# EAGLE board BMS (EAGLE 7.5.0), part 1 of 2
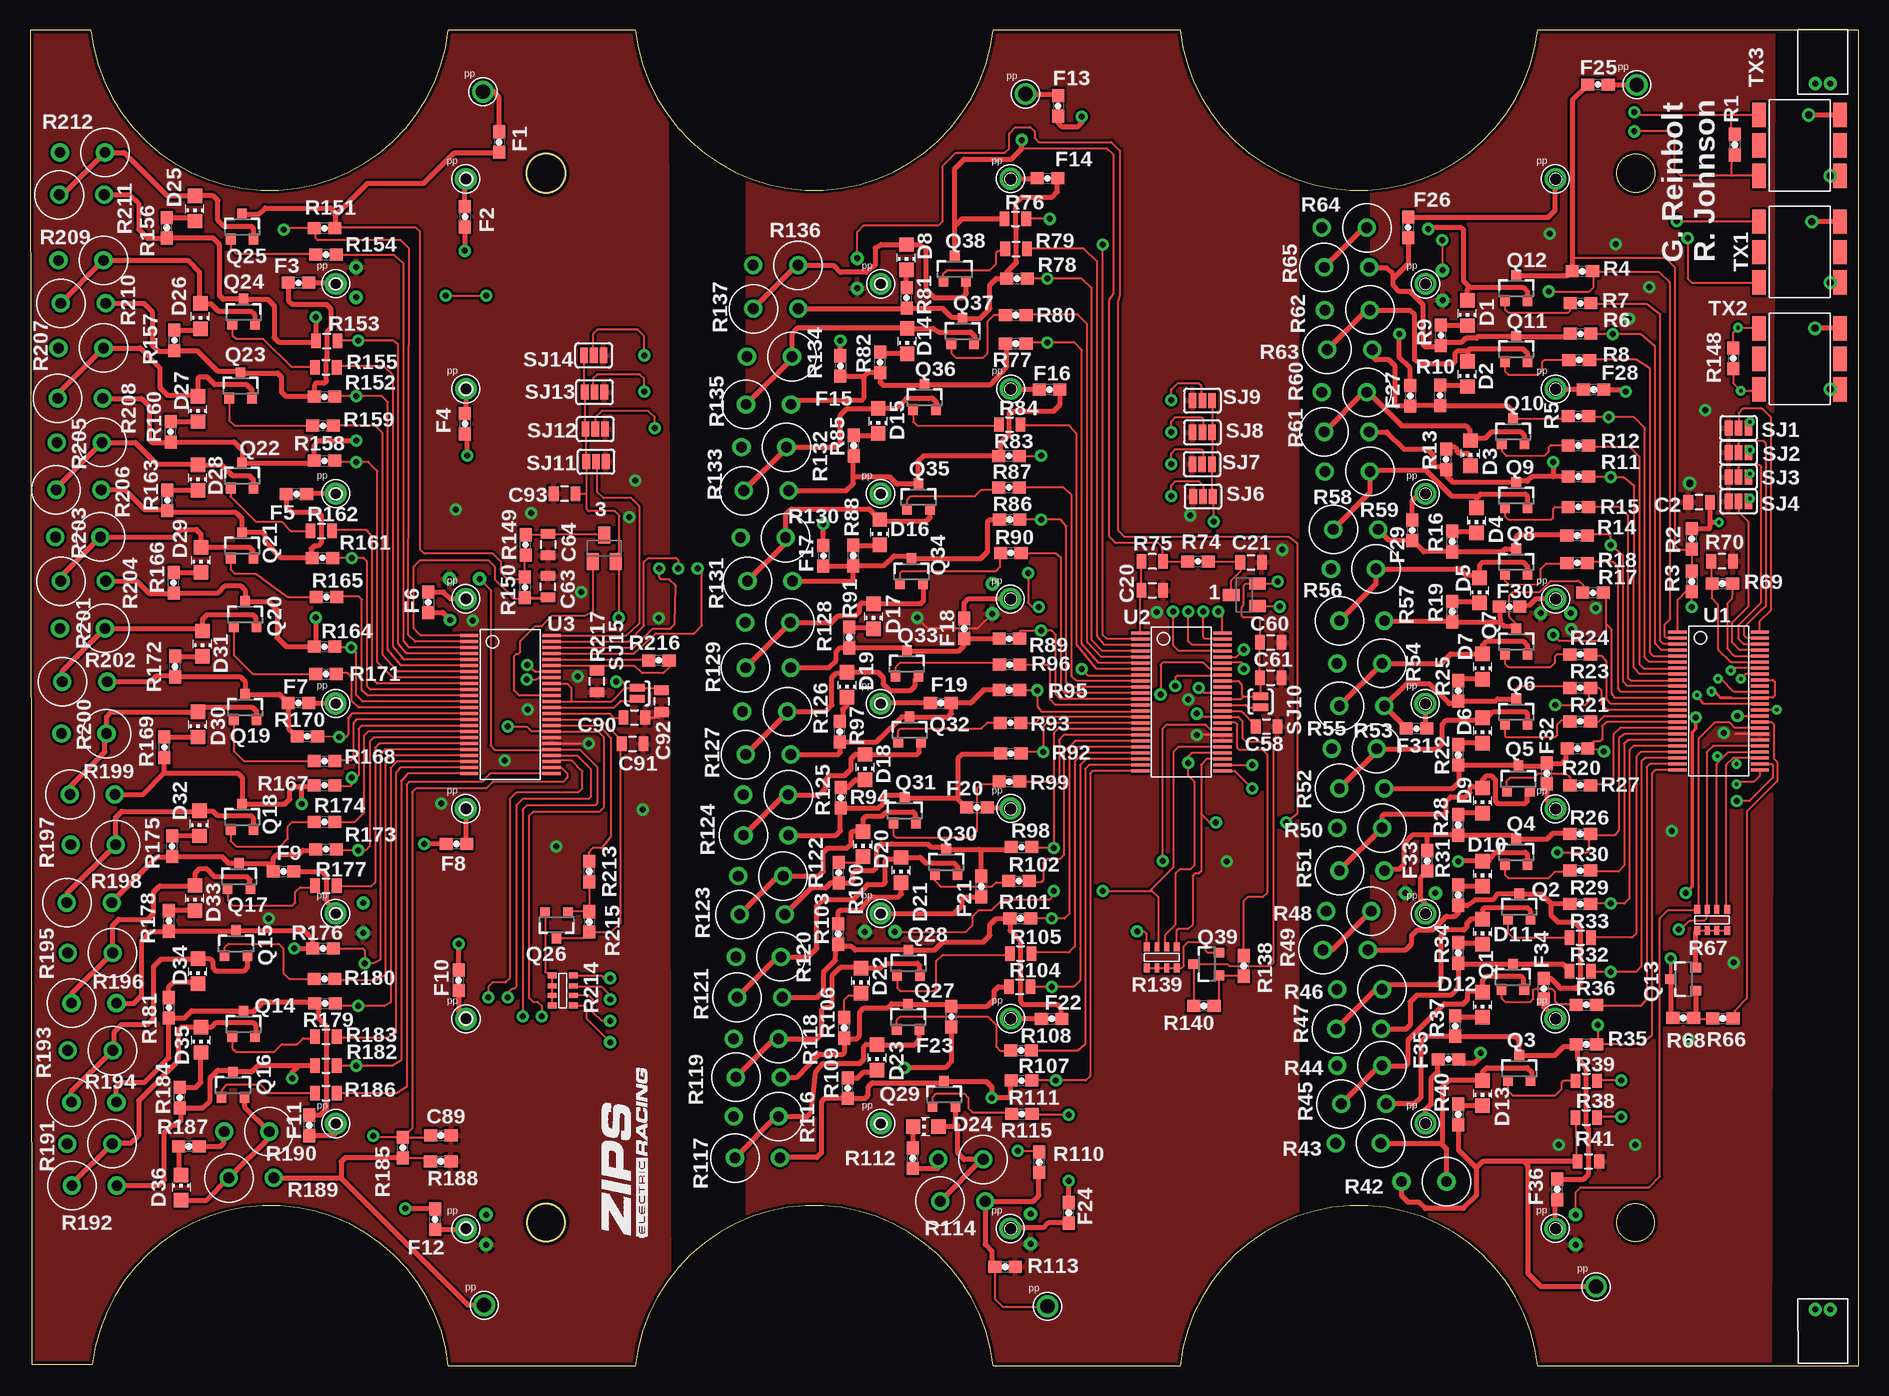
[diagram p3: board, top side]
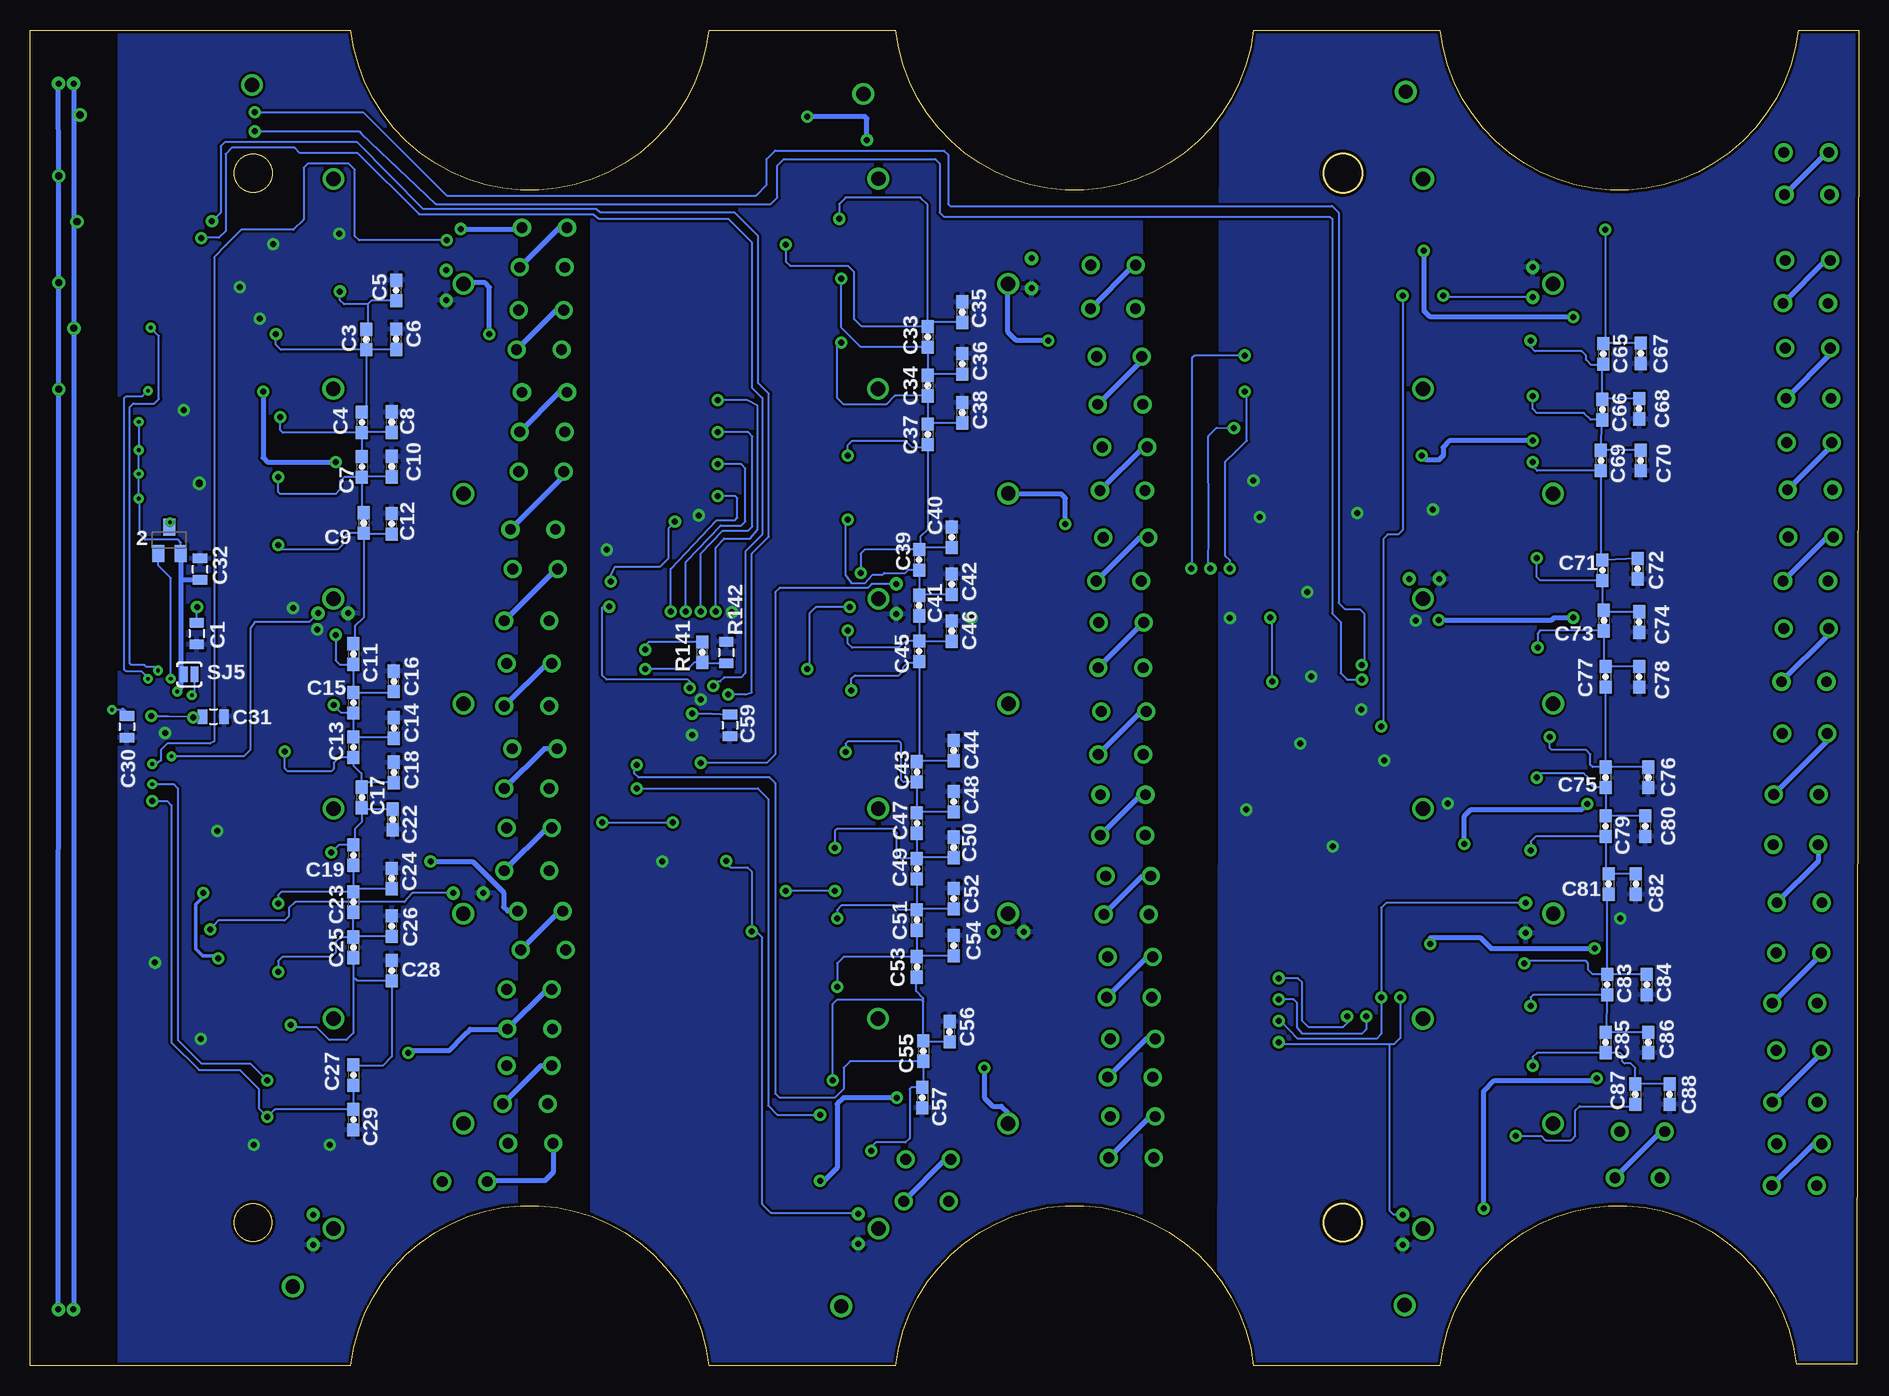
[diagram p4: board, bottom side, seen from below]

Size 152.4 x 111.35 mm. Coordinates in mm from the lower left corner, seen from the top.
Outline: 95.83,111.35 arc167 125.65,111.35 152.4,111.35 152.4,0 125.65,0 arc167 95.83,0 80.26,0 arc167 50.44,0 34.87,0 arc167 5.21,0.13 0.15,0.13 0,111.35 5.05,111.35 arc167 34.87,111.35 50.44,111.35 arc167 80.26,111.35 95.83,111.35
Outline: circle at 133.81,99.42 radius 1.6
Outline: circle at 133.81,11.94 radius 1.57
Outline: circle at 43,11.94 radius 1.57
Outline: circle at 43,99.42 radius 1.6
Copper layers (1*16): Top 0.035mm / dielectric 1.5mm / Bottom 0.035mm
Design rules "SparkFun *": minimum track width 7mil, minimum drill 12mil, track to track 8mil, track to pad 8mil, pad to pad 8mil, via to via 8mil, smd to smd 8mil, copper to edge 10mil, drill to drill 8mil, minimum pad ring 12mil, minimum via ring 10mil, stop-mask expansion 4mil, vias tented up to drill 25mil, thermal gap 10mil

## Footprints (pad centres in the part's own frame; a part is rotated, then mirrored left to right if it is on the bottom)
SOT23-BEC = smd 1 x 1.4: B -0.95,-1.1; C 0,1.1; E 0.95,-1.1
0805 = smd 0.8 x 1.2: 1 -0.9,0; 2 0.9,0
0603 = smd 1.1 x 1: 1 -0.85,0; 2 0.85,0
CHIP_LED0805 = smd 1.2 x 1.2: A 0,-1.05; C 0,1.05
DF13-2P = drill 0.5: 1 -0.625,0; 2 0.625,0
SOT23 = smd 0.8 x 0.9: 1 -0.95,-1; 2 0.95,-1; 3 0,1.1
RR02J16RTB = drill 0.9: P$1 -3.75,0; P$2 0,0
MNR14 = smd 0.5 x 0.75: 1 -1.25,-0.9; 4 1.25,-0.9; 5 1.25,0.85; 8 -1.25,0.85 | smd 0.4 x 0.75: 2 -0.4,-0.9; 3 0.4,-0.9; 6 0.4,0.85; 7 -0.4,0.85
NTC-NXRT15XH103FA5B = drill 0.5: P$1 0,0; P$2 2.5,0
PAD-JUMPER-3-NO_YES_SILK = smd 0.635 x 1.27: 1 -0.813,0; 2 0,0; 3 0.813,0
PAD-JUMPER-2-NO_YES_SILK = smd 0.635 x 1.27: 1 -0.45,0; 2 0.45,0
PE-68386NLT = smd 1.143 x 2.032: 1 -3.378,2.54; 2 -3.378,0; 3 -3.378,-2.54; 4 3.353,-2.54; 5 3.353,0; 6 3.353,2.54
SSOP-48 = smd 0.25 x 1.524: 1 -5.75,-3.421; 2 -5.25,-3.421; 3 -4.75,-3.421; 4 -4.25,-3.421; 5 -3.75,-3.421; 6 -3.25,-3.421; 7 -2.75,-3.421; 8 -2.25,-3.421; 9 -1.75,-3.421; 10 -1.25,-3.421; 11 -0.75,-3.421; 12 -0.25,-3.421; 13 0.25,-3.421; 14 0.75,-3.421; 15 1.25,-3.421; 16 1.75,-3.421; 17 2.25,-3.421; 18 2.75,-3.421; 19 3.25,-3.421; 20 3.75,-3.421; 21 4.25,-3.421; 22 4.75,-3.421; 23 5.25,-3.421; 24 5.75,-3.421; 25 5.75,3.421; 26 5.25,3.421; 27 4.75,3.421; 28 4.25,3.421; 29 3.75,3.421; 30 3.25,3.421; 31 2.75,3.421; 32 2.25,3.421; 33 1.75,3.421; 34 1.25,3.421; 35 0.75,3.421; 36 0.25,3.421; 37 -0.25,3.421; 38 -0.75,3.421; 39 -1.25,3.421; 40 -1.75,3.421; 41 -2.25,3.421; 42 -2.75,3.421; 43 -3.25,3.421; 44 -3.75,3.421; 45 -4.25,3.421; 46 -4.75,3.421; 47 -5.25,3.421; 48 -5.75,3.421
POGOPIN = drill 1.2: 1 0,0

## Placement (x,y rotation side)
1  BCV71SMD  [SOT23-BEC]  101.19,64.26 90 top
2  BCV71SMD  [SOT23-BEC]  140.78,68.82 0 bottom
3  BCV71SMD  [SOT23-BEC]  47.85,68.15 0 top
C1  0.1UF  [0805]  138.51,61.04 270 bottom
C2  0.1UF  [0805]  139.09,71.98 180 top
C3  10NF  [0603]  124.38,85.55 270 bottom
C4  10NF  [0603]  124.74,78.64 270 bottom
C5  DNP  [0603]  121.89,89.64 90 bottom
C6  DNP  [0603]  121.89,85.57 90 bottom
C7  10NF  [0603]  124.74,74.93 270 bottom
C8  DNP  [0603]  122.25,78.66 90 bottom
C9  10NF  [0603]  124.59,70.26 270 bottom
C10  DNP  [0603]  122.25,74.96 90 bottom
C11  10NF  [0603]  125.45,59.33 270 bottom
C12  DNP  [0603]  122.25,70.18 90 bottom
C13  10NF  [0603]  125.45,51.56 270 bottom
C14  DNP  [0603]  122.07,53.16 90 bottom
C15  10NF  [0603]  125.45,55.27 270 bottom
C16  DNP  [0603]  122.07,57.05 90 bottom
C17  10NF  [0603]  124.74,47.37 270 bottom
C18  DNP  [0603]  122.07,49.45 90 bottom
C19  10NF  [0603]  125.45,42.57 270 bottom
C20  0.1UF  [0805]  93.52,64.64 0 top
C21  0.1UF  [0805]  101.75,66.98 0 top
C22  DNP  [0603]  122.17,45.54 270 bottom
C23  10NF  [0603]  125.45,38.66 270 bottom
C24  DNP  [0603]  122.25,40.61 90 bottom
C25  10NF  [0603]  125.45,34.87 270 bottom
C26  DNP  [0603]  122.25,36.65 90 bottom
C27  10NF  [0603]  125.45,24.23 270 bottom
C28  DNP  [0603]  122.25,32.94 90 bottom
C29  10NF  [0603]  125.45,20.52 270 bottom
C30  1UF  [0805]  144.33,53.26 270 bottom
C31  1UF  [0805]  137.12,54.11 0 bottom
C32  1UF  [0805]  138.22,66.4 90 bottom
C33  10NF  [0603]  77.6,85.78 270 bottom
C34  10NF  [0603]  77.6,81.71 270 bottom
C35  DNP  [0603]  74.7,87.83 90 bottom
C36  DNP  [0603]  74.7,83.52 90 bottom
C37  10NF  [0603]  77.6,77.65 270 bottom
C38  DNP  [0603]  74.7,79.45 90 bottom
C39  10NF  [0603]  78.31,67.18 270 bottom
C40  DNP  [0603]  75.59,69.06 90 bottom
C41  10NF  [0603]  78.31,63.37 270 bottom
C42  DNP  [0603]  75.59,65.15 90 bottom
C43  10NF  [0603]  78.49,49.5 270 bottom
C44  DNP  [0603]  75.41,51.28 90 bottom
C45  10NF  [0603]  78.31,59.56 270 bottom
C46  DNP  [0603]  75.59,61.24 90 bottom
C47  10NF  [0603]  78.49,45.24 270 bottom
C48  DNP  [0603]  75.41,47.02 90 bottom
C49  10NF  [0603]  78.49,41.43 270 bottom
C50  DNP  [0603]  75.41,43.21 90 bottom
C51  10NF  [0603]  78.49,37.16 270 bottom
C52  DNP  [0603]  75.41,38.94 90 bottom
C53  10NF  [0603]  78.49,33.25 270 bottom
C54  DNP  [0603]  75.41,35.03 90 bottom
C55  10NF  [0603]  77.95,26.24 270 bottom
C56  DNP  [0603]  75.77,27.84 90 bottom
C57  10NF  [0603]  78.04,22.35 270 bottom
C58  1UF  [0805]  103.05,53.29 0 top
C59  1UF  [0805]  94.08,53.39 270 bottom
C60  1UF  [0805]  103.4,60.3 0 top
C61  1UF  [0805]  103.4,57.36 0 top
C63  0.1UF  [0805]  43.15,64.95 90 top
C64  0.1UF  [0805]  43.18,68.45 270 top
C65  10NF  [0603]  21.29,84.35 270 bottom
C66  10NF  [0603]  21.36,79.71 270 bottom
C67  DNP  [0603]  18.16,84.4 270 bottom
C68  DNP  [0603]  18.31,79.78 270 bottom
C69  10NF  [0603]  21.49,75.46 270 bottom
C70  DNP  [0603]  18.19,75.46 270 bottom
C71  10NF  [0603]  21.36,66.32 270 bottom
C72  DNP  [0603]  18.44,66.45 270 bottom
C73  10NF  [0603]  21.23,62.13 270 bottom
C74  DNP  [0603]  18.31,62 270 bottom
C75  10NF  [0603]  21.11,49.05 270 bottom
C76  DNP  [0603]  17.55,49.05 270 bottom
C77  10NF  [0603]  21.11,57.43 270 bottom
C78  DNP  [0603]  18.31,57.43 270 bottom
C79  10NF  [0603]  21.11,44.98 270 bottom
C80  DNP  [0603]  17.81,44.98 270 bottom
C81  10NF  [0603]  20.85,40.16 270 bottom
C82  DNP  [0603]  18.57,40.16 270 bottom
C83  10NF  [0603]  20.98,31.78 270 bottom
C84  DNP  [0603]  17.68,31.78 270 bottom
C85  10NF  [0603]  21.11,26.95 270 bottom
C86  DNP  [0603]  17.55,26.95 270 bottom
C87  10NF  [0603]  18.62,22.63 270 bottom
C88  DNP  [0603]  15.77,22.63 270 bottom
C89  10NF  [0603]  34.23,19.21 0 top
C90  1UF  [0805]  50.37,54.04 0 top
C91  1UF  [0805]  50.22,51.84 0 top
C92  1UF  [0805]  52.63,55.4 270 top
C93  1UF  [0805]  44.54,72.7 180 top
D1  LED_RED  [CHIP_LED0805]  119.79,87.76 180 top
D2  LED_RED  [CHIP_LED0805]  119.79,82.68 180 top
D3  LED_RED  [CHIP_LED0805]  120.04,76.07 180 top
D4  LED_RED  [CHIP_LED0805]  120.55,70.48 180 top
D5  LED_RED  [CHIP_LED0805]  120.8,64.64 180 top
D6  LED_RED  [CHIP_LED0805]  121.06,52.96 180 top
D7  LED_RED  [CHIP_LED0805]  121.06,58.29 180 top
D8  LED_RED  [CHIP_LED0805]  73.03,92.41 180 top
D9  LED_RED  [CHIP_LED0805]  121.06,47.12 180 top
D10  LED_RED  [CHIP_LED0805]  121.06,41.02 180 top
D11  LED_RED  [CHIP_LED0805]  121.06,36.2 180 top
D12  LED_RED  [CHIP_LED0805]  121.06,30.1 180 top
D13  LED_RED  [CHIP_LED0805]  121.06,22.73 180 top
D14  LED_RED  [CHIP_LED0805]  73.1,85.42 180 top
D15  LED_RED  [CHIP_LED0805]  70.69,78.77 180 top
D16  LED_RED  [CHIP_LED0805]  70.82,69.49 180 top
D17  LED_RED  [CHIP_LED0805]  70.31,62.48 180 top
D18  LED_RED  [CHIP_LED0805]  69.6,49.91 180 top
D19  LED_RED  [CHIP_LED0805]  68.1,56.77 180 top
D20  LED_RED  [CHIP_LED0805]  69.42,43.48 180 top
D21  LED_RED  [CHIP_LED0805]  72.59,41.33 180 top
D22  LED_RED  [CHIP_LED0805]  69.24,32.11 180 top
D23  LED_RED  [CHIP_LED0805]  70.59,25.7 180 top
D24  LED_RED  [CHIP_LED0805]  74.65,19.94 90 top
D25  LED_RED  [CHIP_LED0805]  13.74,96.47 180 top
D26  LED_RED  [CHIP_LED0805]  14.2,87.5 180 top
D27  LED_RED  [CHIP_LED0805]  14,79.76 180 top
D28  LED_RED  [CHIP_LED0805]  14,74.04 180 top
D29  LED_RED  [CHIP_LED0805]  14.25,67.18 180 top
D30  LED_RED  [CHIP_LED0805]  14,53.47 180 top
D31  LED_RED  [CHIP_LED0805]  14.38,60.2 180 top
D32  LED_RED  [CHIP_LED0805]  14.12,45.21 180 top
D33  LED_RED  [CHIP_LED0805]  13.74,38.99 180 top
D34  LED_RED  [CHIP_LED0805]  14,32.89 180 top
D35  LED_RED  [CHIP_LED0805]  14.25,27.18 180 top
D36  LED_RED  [CHIP_LED0805]  12.6,14.86 0 top
F1  FUSE_750MA_63V_0603  [0603]  39.09,102.01 270 top
F2  FUSE_750MA_63V_0603  [0603]  36.25,95.78 270 top
F3  FUSE_750MA_63V_0603  [0603]  22.38,90.27 180 top
F4  FUSE_750MA_63V_0603  [0603]  36.25,78.54 270 top
F5  FUSE_750MA_63V_0603  [0603]  22.2,72.67 180 top
F6  FUSE_750MA_63V_0603  [0603]  33.2,63.65 270 top
F7  FUSE_750MA_63V_0603  [0603]  22.38,55.25 180 top
F8  FUSE_750MA_63V_0603  [0603]  35.53,43.51 180 top
F9  FUSE_750MA_63V_0603  [0603]  21.13,41.2 180 top
F10  FUSE_750MA_63V_0603  [0603]  35.71,32.13 90 top
F11  FUSE_750MA_63V_0603  [0603]  23.27,20.04 90 top
F12  FUSE_750MA_63V_0603  [0603]  33.76,12.22 90 top
F13  FUSE_750MA_63V_0603  [0603]  85.67,105.03 270 top
F14  FUSE_750MA_63V_0603  [0603]  84.79,98.98 0 top
F15  FUSE_750MA_63V_0603  [0603]  67.54,83.34 270 top
F16  FUSE_750MA_63V_0603  [0603]  84.96,81.38 0 top
F17  FUSE_750MA_63V_0603  [0603]  66.12,67.51 270 top
F18  FUSE_750MA_63V_0603  [0603]  77.85,61.47 270 top
F19  FUSE_750MA_63V_0603  [0603]  75.9,55.25 0 top
F20  FUSE_750MA_63V_0603  [0603]  78.92,46.53 180 top
F21  FUSE_750MA_63V_0603  [0603]  79.27,39.95 90 top
F22  FUSE_750MA_63V_0603  [0603]  85.14,28.93 0 top
F23  FUSE_750MA_63V_0603  [0603]  76.78,29.11 90 top
F24  FUSE_750MA_63V_0603  [0603]  86.56,12.75 90 top
F25  FUSE_750MA_63V_0603  [0603]  130.66,106.81 180 top
F26  FUSE_750MA_63V_0603  [0603]  114.83,94.89 270 top
F27  FUSE_750MA_63V_0603  [0603]  115.01,80.85 270 top
F28  FUSE_750MA_63V_0603  [0603]  130.3,81.38 0 top
F29  FUSE_750MA_63V_0603  [0603]  115.19,69.65 270 top
F30  FUSE_750MA_63V_0603  [0603]  123.29,63.27 180 top
F31  FUSE_750MA_63V_0603  [0603]  115.54,53.11 180 top
F32  FUSE_750MA_63V_0603  [0603]  126.39,49.38 90 top
F33  FUSE_750MA_63V_0603  [0603]  116.43,42.09 90 top
F34  FUSE_750MA_63V_0603  [0603]  126.14,31.45 90 top
F35  FUSE_750MA_63V_0603  [0603]  118.21,25.55 0 top
F36  FUSE_750MA_63V_0603  [0603]  127.28,14.71 90 top
J1  M2_DF13-2P  [DF13-2P]  149.4,4.7 180 top
J2  M2_DF13-2P  [DF13-2P]  149.4,106.88 0 top
Q1  BSS308PE  [SOT23]  123.57,32.39 0 top
Q2  BSS308PE  [SOT23]  124.1,38.23 0 top
Q3  BSS308PE  [SOT23]  124.1,24.77 0 top
Q4  BSS308PE  [SOT23]  123.85,42.8 0 top
Q5  BSS308PE  [SOT23]  124.03,48.9 0 top
Q6  BSS308PE  [SOT23]  123.85,54.48 0 top
Q7  BSS308PE  [SOT23]  123.85,60.33 0 top
Q8  BSS308PE  [SOT23]  123.85,66.98 0 top
Q9  BSS308PE  [SOT23]  123.85,72.52 0 top
Q10  BSS308PE  [SOT23]  123.6,77.85 0 top
Q11  BSS308PE  [SOT23]  123.85,84.71 0 top
Q12  BSS308PE  [SOT23]  123.85,89.79 0 top
Q13  BSS308PE  [SOT23]  137.81,32.23 90 top
Q14  BSS308PE  [SOT23]  17.81,28.45 0 top
Q15  BSS308PE  [SOT23]  17.17,35.18 0 top
Q16  BSS308PE  [SOT23]  16.92,23.37 0 top
Q17  BSS308PE  [SOT23]  17.42,40.77 0 top
Q18  BSS308PE  [SOT23]  17.68,45.72 0 top
Q19  BSS308PE  [SOT23]  17.93,54.86 0 top
Q20  BSS308PE  [SOT23]  17.93,62.61 0 top
Q21  BSS308PE  [SOT23]  17.68,68.33 0 top
Q22  BSS308PE  [SOT23]  17.68,74.17 0 top
Q23  BSS308PE  [SOT23]  17.55,81.66 0 top
Q24  BSS308PE  [SOT23]  17.81,87.81 0 top
Q25  BSS308PE  [SOT23]  17.68,94.92 0 top
Q26  BSS308PE  [SOT23]  43.88,36.77 180 top
Q27  BSS308PE  [SOT23]  73.18,29.03 0 top
Q28  BSS308PE  [SOT23]  73.2,33.55 0 top
Q29  BSS308PE  [SOT23]  76.17,22.61 0 top
Q30  BSS308PE  [SOT23]  76.35,41.96 0 top
Q31  BSS308PE  [SOT23]  72.9,46.25 0 top
Q32  BSS308PE  [SOT23]  73.3,52.98 0 top
Q33  BSS308PE  [SOT23]  73.08,58.5 0 top
Q34  BSS308PE  [SOT23]  73.46,66.19 0 top
Q35  BSS308PE  [SOT23]  74.04,72.39 0 top
Q36  BSS308PE  [SOT23]  74.55,80.7 0 top
Q37  BSS308PE  [SOT23]  77.72,86.21 0 top
Q38  BSS308PE  [SOT23]  77.06,91.39 0 top
Q39  BSS308PE  [SOT23]  98.08,33.49 90 top
R1  DNP  [0603]  142.07,101.79 270 top
R2  100  [0603]  138.48,68.94 90 top
R3  100  [0603]  138.48,65.38 270 top
R4  100  [0603]  129.36,91.24 0 top
R5  100  [0603]  129.03,79.15 0 top
R6  100  [0603]  129.21,86.03 0 top
R7  3.3K  [0603]  129.21,88.57 0 top
R8  3.3K  [0603]  129.11,83.85 0 top
R9  475  [0603]  117.58,85.9 90 top
R10  475  [0603]  117.5,80.9 90 top
R11  100  [0603]  129.03,74.12 0 top
R12  3.3K  [0603]  129.03,76.71 0 top
R13  475  [0603]  118.01,75.56 90 top
R14  100  [0603]  128.93,69.21 0 top
R15  3.3K  [0603]  129.03,71.6 0 top
R16  475  [0603]  118.52,68.71 90 top
R17  100  [0603]  130.25,64.44 0 top
R18  3.3K  [0603]  128.93,66.93 0 top
R19  475  [0603]  118.52,62.87 90 top
R20  100  [0603]  128.96,51.46 0 top
R21  3.3K  [0603]  129.18,53.72 0 top
R22  475  [0603]  119.02,50.93 90 top
R23  100  [0603]  129.18,56.52 0 top
R24  3.3K  [0603]  129.18,59.31 0 top
R25  475  [0603]  119.02,56.26 90 top
R26  100  [0603]  129.18,44.32 0 top
R27  3.3K  [0603]  129.18,48.39 0 top
R28  475  [0603]  119.02,45.09 90 top
R29  100  [0603]  129.18,38.48 0 top
R30  3.3K  [0603]  129.18,41.28 0 top
R31  475  [0603]  119.02,39.24 90 top
R32  100  [0805]  129.18,32.89 0 top
R33  3.3K  [0805]  129.18,35.69 0 top
R34  475  [0603]  119.02,34.42 90 top
R35  100  [0603]  129.69,26.8 0 top
R36  3.3K  [0603]  129.69,30.1 0 top
R37  475  [0603]  118.77,28.32 90 top
R38  100  [0805]  129.69,20.7 0 top
R39  3.3K  [0805]  129.69,23.75 0 top
R40  475  [0603]  119.02,20.95 90 top
R41  0  [0805]  129.87,17.04 0 top
R42  16  [RR02J16RTB]  118.05,15.35 0 top
R43  16  [RR02J16RTB]  112.56,18.54 0 top
R44  16  [RR02J16RTB]  112.67,25.02 0 top
R45  16  [RR02J16RTB]  109.26,21.83 180 top
R46  16  [RR02J16RTB]  112.67,31.37 0 top
R47  16  [RR02J16RTB]  108.86,28.07 180 top
R48  16  [RR02J16RTB]  111.76,37.9 0 top
R49  16  [RR02J16RTB]  107.75,34.67 180 top
R50  16  [RR02J16RTB]  112.67,44.83 0 top
R51  16  [RR02J16RTB]  109.12,41.28 180 top
R52  16  [RR02J16RTB]  109.12,48.13 180 top
R53  16  [RR02J16RTB]  112.22,51.44 0 top
R54  16  [RR02J16RTB]  112.67,58.55 0 top
R55  16  [RR02J16RTB]  109.12,54.99 180 top
R56  16  [RR02J16RTB]  112.17,66.42 0 top
R57  16  [RR02J16RTB]  109.12,62.1 180 top
R58  16  [RR02J16RTB]  111.66,74.55 0 top
R59  16  [RR02J16RTB]  108.61,69.72 180 top
R60  16  [RR02J16RTB]  111.4,81.15 0 top
R61  16  [RR02J16RTB]  107.85,77.85 180 top
R62  16  [RR02J16RTB]  111.66,88.01 0 top
R63  16  [RR02J16RTB]  108.1,84.71 180 top
R64  16  [RR02J16RTB]  111.4,94.87 0 top
R65  16  [RR02J16RTB]  107.85,91.57 180 top
R66  1K  [0603]  141.07,28.96 0 top
R67  10K  [MNR14]  140.17,37.13 180 top
R68  100K  [0603]  137.77,28.99 180 top
R69  1.2K  [0603]  141.03,65.21 0 top
R70  787  [0805]  141.01,67.07 180 top
R71  10K-NTC  [NTC-NXRT15XH103FA5B]  117.71,88.82 90 top
R72  10K-NTC  [NTC-NXRT15XH103FA5B]  125.89,62.74 0 top
R73  10K-NTC  [NTC-NXRT15XH103FA5B]  114.62,39.4 0 top
R74  100  [0603]  97.33,67.06 0 top
R75  100  [0805]  93.52,67.06 180 top
R76  100  [0805]  82.12,95.61 0 top
R77  100  [0603]  82.14,85.22 0 top
R78  100  [0603]  82.25,90.63 0 top
R79  3.3K  [0805]  82.17,93.09 0 top
R80  3.3K  [0603]  82.14,87.58 0 top
R81  475  [0603]  73.05,89.03 90 top
R82  475  [0603]  70.84,83.64 90 top
R83  100  [0603]  81.58,75.84 0 top
R84  3.3K  [0805]  81.64,78.46 0 top
R85  475  [0603]  68.66,76.71 90 top
R86  100  [0603]  81.64,70.54 0 top
R87  3.3K  [0603]  81.58,73.23 0 top
R88  475  [0603]  68.61,67.54 90 top
R89  100  [0603]  81.61,60.6 0 top
R90  3.3K  [0603]  81.74,67.77 0 top
R91  475  [0603]  68.28,60.71 90 top
R92  100  [0603]  81.74,51.03 0 top
R93  3.3K  [0603]  81.71,53.59 0 top
R94  475  [0603]  67.56,47.35 90 top
R95  100  [0603]  81.61,56.34 0 top
R96  3.3K  [0603]  81.64,58.45 0 top
R97  475  [0603]  67.49,52.86 90 top
R98  100  [0603]  82.63,43.23 0 top
R99  3.3K  [0603]  81.61,48.69 0 top
R100  475  [0603]  67.39,41.1 90 top
R101  100  [0603]  82.52,37.29 0 top
R102  3.3K  [0603]  82.42,40.41 0 top
R103  475  [0603]  67.36,35.99 90 top
R104  100  [0805]  82.47,31.6 0 top
R105  3.3K  [0805]  82.55,34.37 0 top
R106  475  [0603]  67.84,28.17 90 top
R107  100  [0603]  82.63,23.77 0 top
R108  3.3K  [0603]  82.58,26.29 0 top
R109  475  [0603]  68.15,23.14 90 top
R110  100  [0603]  84.1,16.97 90 top
R111  3.3K  [0603]  82.65,20.98 0 top
R112  475  [0603]  73.56,17.3 90 top
R113  0  [0603]  81.26,8.25 0 top
R114  16  [RR02J16RTB]  75.84,13.72 180 top
R115  16  [RR02J16RTB]  79.43,17.2 0 top
R116  16  [RR02J16RTB]  62.38,20.78 0 top
R117  16  [RR02J16RTB]  58.75,17.32 180 top
R118  16  [RR02J16RTB]  62.38,27.25 0 top
R119  16  [RR02J16RTB]  58.83,24.05 180 top
R120  16  [RR02J16RTB]  62.59,34.09 0 top
R121  16  [RR02J16RTB]  58.93,30.71 180 top
R122  16  [RR02J16RTB]  62.76,40.82 0 top
R123  16  [RR02J16RTB]  59.16,37.62 180 top
R124  16  [RR02J16RTB]  59.46,44.22 180 top
R125  16  [RR02J16RTB]  63.2,47.6 0 top
R126  16  [RR02J16RTB]  63.12,54.53 0 top
R127  16  [RR02J16RTB]  59.64,50.95 180 top
R128  16  [RR02J16RTB]  63.35,61.95 0 top
R129  16  [RR02J16RTB]  59.64,58.19 180 top
R130  16  [RR02J16RTB]  62.97,69.04 0 top
R131  16  [RR02J16RTB]  59.79,65.41 180 top
R132  16  [RR02J16RTB]  63.04,76.58 0 top
R133  16  [RR02J16RTB]  59.49,72.95 180 top
R134  16  [RR02J16RTB]  63.5,84.12 0 top
R135  16  [RR02J16RTB]  59.66,80.14 180 top
R136  16  [RR02J16RTB]  64.01,91.74 0 top
R137  16  [RR02J16RTB]  60.27,88.11 180 top
R138  1K  [0603]  101.14,33.33 90 top
R139  10K  [MNR14]  94.32,34.02 180 top
R140  100K  [0603]  97.82,30 180 top
R141  1.2K  [0603]  96.37,59.49 90 bottom
R142  787  [0805]  94.38,59.45 270 bottom
R143  10K-NTC  [NTC-NXRT15XH103FA5B]  68.93,89.82 90 top
R144  10K-NTC  [NTC-NXRT15XH103FA5B]  80.2,62.68 90 top
R145  10K-NTC  [NTC-NXRT15XH103FA5B]  69.58,36.18 0 top
R146  10K-NTC  [NTC-NXRT15XH103FA5B]  83.38,10.17 90 top
R147  10K-NTC  [NTC-NXRT15XH103FA5B]  128.8,10.1 90 top
R148  DNP  [0603]  141.93,83.99 270 top
R149  100  [0603]  41.3,68.43 90 top
R150  100  [0603]  41.25,64.9 270 top
R151  100  [0603]  24.54,94.82 180 top
R152  100  [0603]  24.54,80.77 0 top
R153  100  [0805]  24.73,85.42 0 top
R154  3.3K  [0603]  24.66,92.63 0 top
R155  3.3K  [0805]  24.66,83.24 0 top
R156  475  [0603]  11.4,94.87 90 top
R157  475  [0603]  12.04,85.47 90 top
R158  100  [0603]  24.54,75.44 0 top
R159  3.3K  [0603]  24.41,78.36 0 top
R160  475  [0603]  11.71,77.85 90 top
R161  100  [0603]  24.38,67.35 0 top
R162  3.3K  [0805]  24.28,69.6 0 top
R163  475  [0603]  11.46,72.14 90 top
R164  100  [0603]  24.54,59.94 0 top
R165  3.3K  [0603]  24.71,64.08 0 top
R166  475  [0603]  11.96,65.28 90 top
R167  100  [0603]  24.54,48.39 0 top
R168  3.3K  [0603]  24.54,50.42 0 top
R169  475  [0603]  11.2,51.56 90 top
R170  100  [0603]  23.11,52.48 0 top
R171  3.3K  [0603]  24.66,57.66 0 top
R172  475  [0603]  12.09,58.29 90 top
R173  100  [0603]  24.66,43.05 0 top
R174  3.3K  [0603]  24.54,45.34 0 top
R175  475  [0603]  11.84,43.31 90 top
R176  100  [0603]  24.41,34.8 0 top
R177  3.3K  [0805]  24.66,40.01 0 top
R178  475  [0603]  11.58,37.08 90 top
R179  100  [0603]  24.59,30.2 0 top
R180  3.3K  [0603]  24.54,32.26 0 top
R181  475  [0603]  11.58,29.84 90 top
R182  100  [0805]  24.66,25.02 0 top
R183  3.3K  [0805]  24.66,27.43 0 top
R184  475  [0603]  12.47,22.35 90 top
R185  100  [0603]  31.06,18.19 90 top
R186  3.3K  [0805]  24.66,22.73 0 top
R187  475  [0603]  13.23,18.29 180 top
R188  0  [0603]  34.23,17.04 0 top
R189  16  [RR02J16RTB]  16.57,15.66 180 top
R190  16  [RR02J16RTB]  19.93,19.52 0 top
R191  16  [RR02J16RTB]  6.85,18.51 0 top
R192  16  [RR02J16RTB]  3.49,15.02 180 top
R193  16  [RR02J16RTB]  6.88,26.29 0 top
R194  16  [RR02J16RTB]  3.45,21.97 180 top